# Altium schematic sheet fpga-tx.SchDoc (continued)
## Parts (continued)
C?#46  value 0.01uF  [0402]  (hidden comment: CAP 0402)
C?#47  value 0.1uF  [0402]  (hidden comment: CAP 0402)
C?#48  value 0.1uF  [0402]  (hidden comment: CAP 0402)
C?#49  value 1uF  [0402]  (hidden comment: CAP 0402)
C?#50  value 0.01uF  [0402]  (hidden comment: CAP 0402)
L?#1  value 600@100MHz  [0402]  (hidden comment: IND 0402)
L?#2  value 600@100MHz  [0402]  (hidden comment: IND 0402)
L?#3  value 600@100MHz  [0402]  (hidden comment: IND 0402)
L?#4  value 600@100MHz  [0402]  (hidden comment: IND 0402)
L?#5  value 600@100MHz  [0402]  (hidden comment: IND 0402)
L?#6  value 600@100MHz  [0402]  (hidden comment: IND 0402)
L?#7  value 600@100MHz  [0402]  (hidden comment: IND 0402)
L?#8  value 600@100MHz  [0402]  (hidden comment: IND 0402)
L?#9  value 600@100MHz  [0402]  (hidden comment: IND 0402)
L?#10  value 600@100MHz  [0402]  (hidden comment: IND 0402)
U?#1  LFE5U-85F-BG756  (part D of 11)
U?#2  LFE5U-85F-BG756  (part A of 11)
U?#3  LFE5U-85F-BG756  (part B of 11)
U?#4  LFE5U-85F-BG756  (part E of 11)
U?#5  LFE5U-85F-BG756  (part I of 11)
U?#6  LFE5U-85F-BG756  (part F of 11)
U?#7  LFE5U-85F-BG756  (part G of 11)
U?#8  LFE5U-85F-BG756  (part C of 11)
U?#9  LFE5U-85F-BG756  (part K of 11)
U?#10  LFE5U-85F-BG756  (part H of 11)
U?#11  LFE5U-85F-BG756  (part J of 11)

## Ports
CTRL0 (harness CTRL), CTRL1 (harness CTRL), DAC-LVDS (harness DAC-LVDS), EAST (harness NODE-BRIDGE), FPGA-CLK_N, FPGA-CLK_P, FPGA-CONFIG (harness FPGA-CONFIG), GPMC (harness GPMC), NORTH (harness NODE-BRIDGE), TRANSMIT

## Harnesses
DAC-LVDS: DAC-D0_P, DAC-D0_N, DAC-D1_P, DAC-D1_N, DAC-D2_P, DAC-D2_N, DAC-D3_P, DAC-D3_N, DAC-D4_P, DAC-D4_N, DAC-D5_P, DAC-D5_N, DAC-D6_P, DAC-D6_N, DAC-D7_P, DAC-D7_N, DAC-D8_P, DAC-D8_N, DAC-D9_P, DAC-D9_N, DAC-D10_P, DAC-D10_N, DAC-D11_P, DAC-D11_N, DAC-D12_P, DAC-D12_N, DAC-D13_P, DAC-D13_N, DAC-D14_P, DAC-D14_N, DAC-D15_P, DAC-D15_N, DAC-DCLK_P, DAC-DCLK_N, DAC-SYNC_P, DAC-SYNC_N, DAC-PARITY_P, DAC-PARITY_N, DAC-OSTR_P, DAC-OSTR_N, DAC-FRAME_P, DAC-FRAME_N
CTRL: S0, S1, S2, S3, S4, S5
NODE-BRIDGE: DCLK, D0, D1, D2, D3, D4, D5, D6, D7, D8, D9, D10, D11, D12, D13, D14, D15, D16, D17, D18, D19, D20, D21, D22, D23, D24, D25, D26, D27, D28, D29, D30, D31, D32, D33, D34, D35, D36, D37, D38, D39, D40, D41, D42, D43, D44, D45, D46, D47, D48, D49, D50, D51, D52, D53, D54, D55, D56, D57, D58, D59, D60, D61, D62, D63
FPGA-CONFIG: SSN, SCK, MISO, MOSI, DOUT, DIN, DONE, INITN, TDI, TDO, TCK, TMS, PROG_N
GPMC: S0, S1, S2, S3, S4, S5, S6, S7, S8, S9, S10, S11, S12, S13, S14, S15, S16, S17, S18, S19, S20, S21, S22

## Nets
GND: C?#1.1 C?#2.1 C?#3.1 C?#4.1 C?#5.1 C?#6.1 C?#7.1 C?#8.1 C?#9.1 C?#10.1 C?#11.1 C?#12.1 C?#13.1 C?#14.1 C?#15.1 C?#16.1 C?#17.1 C?#18.1 C?#19.1 C?#20.1 C?#21.1 C?#22.1 C?#23.1 C?#24.1 C?#25.1 C?#26.1 C?#27.1 C?#28.1 C?#29.1 C?#30.1 C?#31.1 C?#32.1 C?#33.1 C?#34.1 C?#35.1 C?#36.1 C?#37.1 C?#38.1 C?#39.1 C?#40.1 C?#41.1 C?#42.1 C?#43.1 C?#44.1 C?#45.1 C?#46.1 C?#47.1 C?#48.1 C?#49.1 C?#50.1 U?#5.AA11(GND) U?#5.AA22(GND) U?#5.AB11(GND) U?#5.AB12(GND) U?#5.AB13(GND) U?#5.AB14(GND) U?#5.AB15(GND) U?#5.AB16(GND) U?#5.AB17(GND) U?#5.AB18(GND) U?#5.AB19(GND) U?#5.AB20(GND) U?#5.AB21(GND) U?#5.AB22(GND) U?#5.AC12(GND) U?#5.AC21(GND) U?#5.AD2(GND) U?#5.AD5(GND) U?#5.AD28(GND) U?#5.AD31(GND) U?#5.AF11(GND) U?#5.AF12(GND) U?#5.AF14(GND) U?#5.AF15(GND) U?#5.AF16(GND) U?#5.AF17(GND) U?#5.AF19(GND) U?#5.AF20(GND) U?#5.AF23(GND) U?#5.AG11(GND) U?#5.AG14(GND) U?#5.AG15(GND) U?#5.AG16(GND) U?#5.AG17(GND) U?#5.AG20(GND) U?#5.AG23(GND) U?#5.AH2(GND) U?#5.AH5(GND) U?#5.AH7(GND) U?#5.AH8(GND) U?#5.AH11(GND) U?#5.AH14(GND) U?#5.AH15(GND) U?#5.AH16(GND) U?#5.AH17(GND) U?#5.AH20(GND) U?#5.AH23(GND) U?#5.AH24(GND) U?#5.AH25(GND) U?#5.AH26(GND) U?#5.AH29(GND) U?#5.AH31(GND) U?#5.AJ7(GND) U?#5.AJ8(GND) U?#5.AJ11(GND) U?#5.AJ14(GND) U?#5.AJ17(GND) U?#5.AJ20(GND) U?#5.AJ23(GND) U?#5.AJ26(GND) U?#5.AK7(GND) U?#5.AK8(GND) U?#5.AK11(GND) U?#5.AK14(GND) U?#5.AK17(GND) U?#5.AK20(GND) U?#5.AK23(GND) U?#5.AK26(GND) U?#5.AL2(GND) U?#5.AL5(GND) U?#5.AL7(GND) U?#5.AL8(GND) U?#5.AL9(GND) U?#5.AL11(GND) U?#5.AL12(GND) U?#5.AL14(GND) U?#5.AL15(GND) U?#5.AL17(GND) U?#5.AL18(GND) U?#5.AL20(GND) U?#5.AL21(GND) U?#5.AL23(GND) U?#5.AL24(GND) U?#5.AL26(GND) U?#5.AL29(GND) U?#5.AL31(GND) U?#5.AM7(GND) U?#5.AM14(GND) U?#5.AM15(GND) U?#5.AM26(GND) U?#5.B2(GND) U?#5.B5(GND) U?#5.B9(GND) U?#5.B13(GND) U?#5.B15(GND) U?#5.B18(GND) U?#5.B20(GND) U?#5.B24(GND) U?#5.B28(GND) U?#5.B31(GND) U?#5.E2(GND) U?#5.E5(GND) U?#5.E9(GND) U?#5.E13(GND) U?#5.E15(GND) U?#5.E18(GND) U?#5.E20(GND) U?#5.E24(GND) U?#5.E28(GND) U?#5.E31(GND) U?#5.J2(GND) U?#5.J5(GND) U?#5.J28(GND) U?#5.J31(GND) U?#5.K10(GND) U?#5.K11(GND) U?#5.K22(GND) U?#5.K23(GND) U?#5.L10(GND) U?#5.L11(GND) U?#5.L12(GND) U?#5.L13(GND) U?#5.L14(GND) U?#5.L15(GND) U?#5.L16(GND) U?#5.L17(GND) U?#5.L18(GND) U?#5.L19(GND) U?#5.L20(GND) U?#5.L21(GND) U?#5.L22(GND) U?#5.L23(GND) U?#5.M11(GND) U?#5.M22(GND) U?#5.N2(GND) U?#5.N5(GND) U?#5.N11(GND) U?#5.N13(GND) U?#5.N14(GND) U?#5.N15(GND) U?#5.N16(GND) U?#5.N17(GND) U?#5.N18(GND) U?#5.N19(GND) U?#5.N20(GND) U?#5.N22(GND) U?#5.N28(GND) U?#5.N31(GND) U?#5.P11(GND) U?#5.P13(GND) U?#5.P14(GND) U?#5.P15(GND) U?#5.P16(GND) U?#5.P17(GND) U?#5.P18(GND) U?#5.P19(GND) U?#5.P20(GND) U?#5.P22(GND) U?#5.R2(GND) U?#5.R5(GND) U?#5.R11(GND) U?#5.R13(GND) U?#5.R14(GND) U?#5.R15(GND) U?#5.R16(GND) U?#5.R17(GND) U?#5.R18(GND) U?#5.R19(GND) U?#5.R20(GND) U?#5.R22(GND) U?#5.R28(GND) U?#5.R31(GND) U?#5.T11(GND) U?#5.T13(GND) U?#5.T14(GND) U?#5.T15(GND) U?#5.T16(GND) U?#5.T17(GND) U?#5.T18(GND) U?#5.T19(GND) U?#5.T20(GND) U?#5.T22(GND) U?#5.U11(GND) U?#5.U13(GND) U?#5.U14(GND) U?#5.U15(GND) U?#5.U16(GND) U?#5.U17(GND) U?#5.U18(GND) U?#5.U19(GND) U?#5.U20(GND) U?#5.U22(GND) U?#5.V2(GND) U?#5.V5(GND) U?#5.V11(GND) U?#5.V13(GND) U?#5.V14(GND) U?#5.V15(GND) U?#5.V16(GND) U?#5.V17(GND) U?#5.V18(GND) U?#5.V19(GND) U?#5.V20(GND) U?#5.V22(GND) U?#5.V28(GND) U?#5.V31(GND) U?#5.W11(GND) U?#5.W13(GND) U?#5.W14(GND) U?#5.W15(GND) U?#5.W16(GND) U?#5.W17(GND) U?#5.W18(GND) U?#5.W19(GND) U?#5.W20(GND) U?#5.W22(GND) U?#5.Y2(GND) U?#5.Y11(GND) U?#5.Y13(GND) U?#5.Y14(GND) U?#5.Y15(GND) U?#5.Y16(GND) U?#5.Y17(GND) U?#5.Y18(GND) U?#5.Y19(GND) U?#5.Y20(GND) U?#5.Y22(GND) U?#5.Y31(GND) U?#9.AC13(GND) U?#9.AC14(GND) U?#9.AC15(GND) U?#9.AC16(GND) U?#9.AC17(GND) U?#9.AC18(GND) U?#9.AC19(GND) U?#9.AC20(GND) U?#9.AM8(GND) U?#9.AM9(GND) U?#9.AM11(GND) U?#9.AM12(GND) U?#9.AM17(GND) U?#9.AM18(GND) U?#9.AM20(GND) U?#9.AM21(GND) U?#9.AM23(GND) U?#9.AM24(GND) U?#11.AF22(GND) U?#11.AG9(GND) U?#11.AG12(GND) U?#11.AG19(GND) U?#11.AG22(GND) U?#11.AH9(GND) U?#11.AH12(GND) U?#11.AH19(GND) U?#11.AH22(GND) U?#11.AJ9(GND) U?#11.AJ10(GND) U?#11.AJ12(GND) U?#11.AJ13(GND) U?#11.AJ15(GND) U?#11.AJ16(GND) U?#11.AJ18(GND) U?#11.AJ19(GND) U?#11.AJ21(GND) U?#11.AJ22(GND) U?#11.AJ24(GND) U?#11.AJ25(GND)
PP3V3: C?#3.2 C?#6.2 C?#12.2 C?#18.2 C?#24.2 C?#30.2 C?#34.2 C?#40.2 C?#46.2 C?#50.2 L?#1.1 L?#2.1 L?#3.1 L?#4.1 L?#5.1 L?#6.1 L?#7.1 L?#8.1 L?#9.1 L?#10.1
CTRL0.S0: U?#4.AH28(PB112B)
CTRL0.S1: U?#4.AH30(PB114A)
CTRL0.S2: U?#4.AG30(PB114B)
CTRL0.S3: U?#4.AK29(PB116A)
CTRL0.S4: U?#4.AK30(PB116B)
CTRL0.S5: U?#4.AH32(PB119A)
CTRL1.S0: U?#4.AJ29(PB121A)
CTRL1.S1: U?#4.AJ30(PB121B)
CTRL1.S2: U?#4.AM28(PB96A)
CTRL1.S3: U?#4.AM29(PB96B)
CTRL1.S4: U?#4.AL28(PB98A)
CTRL1.S5: U?#4.AK28(PB98B)
DAC-D0_N: U?#7.D5(PL11B/_ULC_GPLL0C_IN) ; port DAC-LVDS.DAC-D0_N
DAC-D0_P: U?#7.C5(PL11A/_ULC_GPLL0T_IN) ; port DAC-LVDS.DAC-D0_P
DAC-D1_N: U?#7.C3(PL11D/_ULC_GPLL0C_MFGOUT2) ; port DAC-LVDS.DAC-D1_N
DAC-D1_P: U?#7.C4(PL11C/_ULC_GPLL0T_MFGOUT2) ; port DAC-LVDS.DAC-D1_P
DAC-D2_N: U?#7.E4(PL14B/_ULC_GPLL0C_MFGOUT1) ; port DAC-LVDS.DAC-D2_N
DAC-D2_P: U?#7.D4(PL14A/_ULC_GPLL0T_MFGOUT1) ; port DAC-LVDS.DAC-D2_P
DAC-D3_N: U?#7.F5(PL14D) ; port DAC-LVDS.DAC-D3_N
DAC-D3_P: U?#7.F4(PL14C) ; port DAC-LVDS.DAC-D3_P
DAC-D4_N: U?#7.D2(PL17D) ; port DAC-LVDS.DAC-D4_N
DAC-D4_P: U?#7.D3(PL17C) ; port DAC-LVDS.DAC-D4_P
DAC-D5_N: U?#7.E3(PL20B) ; port DAC-LVDS.DAC-D5_N
DAC-D5_P: U?#7.F3(PL20A) ; port DAC-LVDS.DAC-D5_P
DAC-D6_N: U?#7.D1(PL20D) ; port DAC-LVDS.DAC-D6_N
DAC-D6_P: U?#7.C1(PL20C) ; port DAC-LVDS.DAC-D6_P
DAC-D7_N: U?#7.E1(PL23B) ; port DAC-LVDS.DAC-D7_N
DAC-D7_P: U?#7.F2(PL23A) ; port DAC-LVDS.DAC-D7_P
DAC-D8_N: U?#7.H1(PL23D) ; port DAC-LVDS.DAC-D8_N
DAC-D8_P: U?#7.F1(PL23C) ; port DAC-LVDS.DAC-D8_P
DAC-D9_N: U?#7.H3(PL26B) ; port DAC-LVDS.DAC-D9_N
DAC-D9_P: U?#7.H2(PL26A) ; port DAC-LVDS.DAC-D9_P
DAC-D10_N: U?#7.K3(PL26D) ; port DAC-LVDS.DAC-D10_N
DAC-D10_P: U?#7.J3(PL26C) ; port DAC-LVDS.DAC-D10_P
DAC-D11_N: U?#7.L1(PL29D) ; port DAC-LVDS.DAC-D11_N
DAC-D11_P: U?#7.K1(PL29C) ; port DAC-LVDS.DAC-D11_P
DAC-D12_N: U?#7.L3(PL32B) ; port DAC-LVDS.DAC-D12_N
DAC-D12_P: U?#7.L2(PL32A) ; port DAC-LVDS.DAC-D12_P
DAC-D13_N: U?#7.K4(PL32D) ; port DAC-LVDS.DAC-D13_N
DAC-D13_P: U?#7.J4(PL32C) ; port DAC-LVDS.DAC-D13_P
DAC-D14_N: U?#7.J6(PL35D) ; port DAC-LVDS.DAC-D14_N
DAC-D14_P: U?#7.J7(PL35C/_VREF1_7) ; port DAC-LVDS.DAC-D14_P
DAC-D15_N: U?#7.K7(PL38B) ; port DAC-LVDS.DAC-D15_N
DAC-D15_P: U?#7.K6(PL38A) ; port DAC-LVDS.DAC-D15_P
DAC-DCLK_N: U?#7.C2(PL17B) ; port DAC-LVDS.DAC-DCLK_N
DAC-DCLK_P: U?#7.B1(PL17A) ; port DAC-LVDS.DAC-DCLK_P
DAC-FRAME_N: U?#7.N7(PL44B/_PCLKC7_1) ; port DAC-LVDS.DAC-FRAME_N
DAC-FRAME_P: U?#7.N6(PL44A/_PCLKT7_1) ; port DAC-LVDS.DAC-FRAME_P
DAC-OSTR_N: U?#7.L6(PL41D) ; port DAC-LVDS.DAC-OSTR_N
DAC-OSTR_P: U?#7.L7(PL41C/_GR_PCLK7_0) ; port DAC-LVDS.DAC-OSTR_P
DAC-PARITY_N: U?#7.N4(PL41B) ; port DAC-LVDS.DAC-PARITY_N
DAC-PARITY_P: U?#7.N3(PL41A/_GR_PCLK7_1) ; port DAC-LVDS.DAC-PARITY_P
DAC-REFCLK_N: U?#1.AE32(PR92D/_LRC_GPLL0C_IN/S7_OUT) ; port FPGA-CLK_N
DAC-REFCLK_P: U?#1.AD32(PR92C/_LRC_GPLL0T_IN) ; port FPGA-CLK_P
DAC-SYNC_N: U?#7.L4(PL38D) ; port DAC-LVDS.DAC-SYNC_N
DAC-SYNC_P: U?#7.K5(PL38C) ; port DAC-LVDS.DAC-SYNC_P
EAST.D0: U?#1.P28(PR47A/_PCLKT3_1/S3_OUT)
EAST.D1: U?#1.P29(PR47B/_PCLKC3_1)
EAST.D2: U?#1.R26(PR47C/_PCLKT3_0/S4_IN)
EAST.D3: U?#1.T26(PR47D/_PCLKC3_0)
EAST.D4: U?#1.R27(PR50A/_GR_PCLK3_0)
EAST.D5: U?#1.T27(PR50B)
EAST.D6: U?#1.U27(PR50C/_GR_PCLK3_1)
EAST.D7: U?#1.U26(PR50D)
EAST.D8: U?#1.R29(PR53A)
EAST.D9: U?#1.T28(PR53B)
EAST.D10: U?#1.T29(PR53C)
EAST.D11: U?#1.U28(PR53D)
EAST.D12: U?#1.U29(PR56A/_S4_OUT)
EAST.D13: U?#1.V29(PR56B/_VREF1_3)
EAST.D14: U?#1.V27(PR56C/_S5_IN)
EAST.D15: U?#1.V26(PR56D)
EAST.D16: U?#1.P31(PR59A)
EAST.D17: U?#1.P30(PR59B)
EAST.D18: U?#1.R30(PR59C)
EAST.D19: U?#1.T30(PR59D)
EAST.D20: U?#1.N32(PR62A)
EAST.D21: U?#1.P32(PR62B)
EAST.D22: U?#1.U31(PR62C)
EAST.D23: U?#1.U30(PR62D)
EAST.D24: U?#1.R32(PR65A)
EAST.D25: U?#1.T31(PR65B)
EAST.D26: U?#1.W30(PR65C)
EAST.D27: U?#1.Y30(PR65D)
EAST.D28: U?#1.T32(PR68A)
EAST.D29: U?#1.U32(PR68B)
EAST.D30: U?#1.V32(PR68C)
EAST.D31: U?#1.W32(PR68D)
EAST.D32: U?#1.Y26(PR71A)
EAST.D33: U?#1.Y27(PR71B)
EAST.D34: U?#1.Y28(PR71C)
EAST.D35: U?#1.W28(PR71D)
EAST.D36: U?#1.Y29(PR74A)
EAST.D37: U?#1.W29(PR74B)
EAST.D38: U?#1.AB26(PR74C)
EAST.D39: U?#1.AC27(PR74D)
EAST.D40: U?#1.AB28(PR77A)
EAST.D41: U?#1.AB27(PR77B)
EAST.D42: U?#1.AC26(PR77C)
EAST.D43: U?#1.AD26(PR77D)
EAST.D44: U?#1.AD27(PR80A)
EAST.D45: U?#1.AE27(PR80B)
EAST.D46: U?#1.AE28(PR80C)
EAST.D47: U?#1.AE29(PR80D)
EAST.D48: U?#1.AB29(PR83B/_S6_IN)
EAST.D49: U?#1.AC28(PR83C)
EAST.D50: U?#1.AD29(PR83D)
EAST.D51: U?#1.W31(PR86A/_S6_OUT)
EAST.D52: U?#1.Y32(PR86B/_S7_IN)
EAST.D53: U?#1.AD30(PR86C)
EAST.D54: U?#1.AE30(PR86D)
EAST.D55: U?#1.AC30(PR89A)
EAST.D56: U?#1.AB31(PR89B)
EAST.D57: U?#1.AC31(PR89C/_LRC_GPLL0T_MFGOUT2)
EAST.D58: U?#1.AE31(PR89D/_LRC_GPLL0C_MFGOUT2)
EAST.D59: U?#1.AB32(PR92A/_LRC_GPLL0T_MFGOUT1)
EAST.D60: U?#1.AC32(PR92B/_LRC_GPLL0C_MFGOUT1)
EAST.D61: U?#4.AK32(PB101A)
EAST.D62: U?#4.AJ32(PB101B)
EAST.D63: U?#4.AM30(PB103A)
EAST.DCLK: U?#1.AB30(PR83A/_S5_OUT)
FPGA-CONFIG.DIN: U?#10.AJ3(PB15A/_HOLDN/DI/BUSY/CSSPIN/CEN) ; port FPGA-CONFIG.DIN
FPGA-CONFIG.DONE: U?#10.AJ4(DONE) ; port FPGA-CONFIG.DONE
FPGA-CONFIG.DOUT: U?#10.AK3(PB15B/_DOUT/CSON/ATB_FORCE) ; port FPGA-CONFIG.DOUT
FPGA-CONFIG.INITN: U?#10.AG4(INITN) ; port FPGA-CONFIG.INITN
FPGA-CONFIG.MISO: U?#10.AJ2(PB11A/_D1/MISO/IO1) ; port FPGA-CONFIG.MISO
FPGA-CONFIG.MOSI: U?#10.AK2(PB11B/_D0/MOSI/IO0) ; port FPGA-CONFIG.MOSI
FPGA-CONFIG.PROG_N: U?#10.AH4(PROGRAMN) ; port FPGA-CONFIG.PROG_N
FPGA-CONFIG.SCK: U?#10.AM3(CCLK/_MCLK/SCK) ; port FPGA-CONFIG.SCK
FPGA-CONFIG.SSN: U?#10.AG3(PB13A/_SN/CSN/SCAN_SHFT_EN) ; port FPGA-CONFIG.SSN
FPGA-CONFIG.TCK: U?#10.AK5(TCK/_TEST_CLK) ; port FPGA-CONFIG.TCK
FPGA-CONFIG.TDI: U?#10.AJ5(TDI) ; port FPGA-CONFIG.TDI
FPGA-CONFIG.TDO: U?#10.AG5(TDO) ; port FPGA-CONFIG.TDO
FPGA-CONFIG.TMS: U?#10.AM5(TMS) ; port FPGA-CONFIG.TMS
GPMC.S0: U?#3.F18(PT74B/_GR_PCLK1_1) ; port GPMC.S0
GPMC.S1: U?#3.A19(PT76A) ; port GPMC.S1
GPMC.S2: U?#3.B19(PT76B) ; port GPMC.S2
GPMC.S3: U?#3.C19(PT78A) ; port GPMC.S3
GPMC.S4: U?#3.D19(PT78B) ; port GPMC.S4
GPMC.S5: U?#3.E19(PT80A) ; port GPMC.S5
GPMC.S6: U?#3.F19(PT80B) ; port GPMC.S6
GPMC.S7: U?#3.A20(PT83A) ; port GPMC.S7
GPMC.S8: U?#3.C20(PT83B) ; port GPMC.S8
GPMC.S9: U?#3.D20(PT85A) ; port GPMC.S9
GPMC.S10: U?#3.F20(PT85B) ; port GPMC.S10
GPMC.S11: U?#3.A22(PT87A) ; port GPMC.S11
GPMC.S12: U?#3.B22(PT87B) ; port GPMC.S12
GPMC.S13: U?#3.C22(PT89A) ; port GPMC.S13
GPMC.S14: U?#3.D22(PT89B) ; port GPMC.S14
GPMC.S15: U?#3.E22(PT92A) ; port GPMC.S15
GPMC.S16: U?#3.F22(PT92B) ; port GPMC.S16
GPMC.S17: U?#3.A23(PT94A) ; port GPMC.S17
GPMC.S18: U?#3.B23(PT94B) ; port GPMC.S18
GPMC.S19: U?#3.C23(PT96A) ; port GPMC.S19
GPMC.S20: U?#3.D23(PT96B) ; port GPMC.S20
GPMC.S21: U?#3.E23(PT98A) ; port GPMC.S21
GPMC.S22: U?#3.F23(PT98B) ; port GPMC.S22
NORTH.D0: U?#8.C28(PR11A/_URC_GPLL0T_IN)
NORTH.D1: U?#8.D28(PR11B/_URC_GPLL0C_IN/S0_IN)
NORTH.D2: U?#8.C29(PR11C/_URC_GPLL0T_MFGOUT2)
NORTH.D3: U?#8.C30(PR11D/_URC_GPLL0C_MFGOUT2)
NORTH.D4: U?#8.D29(PR14A/_S0_OUT)
NORTH.D5: U?#8.E29(PR14B/_S1_IN)
NORTH.D6: U?#8.F29(PR14C)
NORTH.D7: U?#8.F28(PR14D)
NORTH.D8: U?#8.B32(PR17A/_URC_GPLL0T_MFGOUT1)
NORTH.D9: U?#8.C31(PR17B/_URC_GPLL0C_MFGOUT1)
NORTH.D10: U?#8.D30(PR17C)
NORTH.D11: U?#8.D31(PR17D)
NORTH.D12: U?#8.F30(PR20A)
NORTH.D13: U?#8.E30(PR20B)
NORTH.D14: U?#8.C32(PR20C)
NORTH.D15: U?#8.D32(PR20D)
NORTH.D16: U?#8.F31(PR23A)
NORTH.D17: U?#8.E32(PR23B)
NORTH.D18: U?#8.F32(PR23C)
NORTH.D19: U?#8.H32(PR23D)
NORTH.D20: U?#8.H31(PR26A)
NORTH.D21: U?#8.H30(PR26B)
NORTH.D22: U?#8.J30(PR26C)
NORTH.D23: U?#8.K30(PR26D)
NORTH.D24: U?#8.K31(PR29A)
NORTH.D25: U?#8.J32(PR29B)
NORTH.D26: U?#8.K32(PR29C)
NORTH.D27: U?#8.L32(PR29D)
NORTH.D28: U?#8.L31(PR32A)
NORTH.D29: U?#8.L30(PR32B)
NORTH.D30: U?#8.J29(PR32C)
NORTH.D31: U?#8.K29(PR32D)
NORTH.D32: U?#8.H27(PR35A/_S1_OUT)
NORTH.D33: U?#8.H28(PR35B/_S2_IN)
NORTH.D34: U?#8.J26(PR35C/_VREF1_2)
NORTH.D35: U?#8.J27(PR35D)
NORTH.D36: U?#8.K27(PR38A)
NORTH.D37: U?#8.K26(PR38B)
NORTH.D38: U?#8.K28(PR38C)
NORTH.D39: U?#8.L29(PR38D)
NORTH.D40: U?#8.N29(PR41B)
NORTH.D41: U?#8.L26(PR41C/_GR_PCLK2_0)
NORTH.D42: U?#8.L27(PR41D)
NORTH.D43: U?#8.N27(PR44A/_PCLKT2_1/S2_OUT)
NORTH.D44: U?#8.N26(PR44B/_PCLKC2_1)
NORTH.D45: U?#8.P27(PR44C/_PCLKT2_0/S3_IN)
NORTH.D46: U?#8.P26(PR44D/_PCLKC2_0)
NORTH.D47: U?#3.A24(PT101A)
NORTH.D48: U?#3.C24(PT101B)
NORTH.D49: U?#3.D24(PT103A)
NORTH.D50: U?#3.F24(PT103B)
NORTH.D51: U?#3.A25(PT105A)
NORTH.D52: U?#3.B25(PT105B)
NORTH.D53: U?#3.C25(PT107A)
NORTH.D54: U?#3.D25(PT107B)
NORTH.D55: U?#3.E25(PT110A)
NORTH.D56: U?#3.F25(PT110B)
NORTH.D57: U?#3.A26(PT112A)
NORTH.D58: U?#3.B26(PT112B)
NORTH.D59: U?#3.C26(PT114A)
NORTH.D60: U?#3.D26(PT114B)
NORTH.D61: U?#3.A28(PT116A)
NORTH.D62: U?#3.A29(PT116B)
NORTH.D63: U?#3.A30(PT119A)
NORTH.DCLK: U?#8.N30(PR41A/_GR_PCLK2_1)
TRANSMIT: U?#7.P7(PL44D/_PCLKC7_0) ; port TRANSMIT
VCC-CORE: C?#1.2 C?#2.2 L?#1.2 U?#11.AA12(VCC) U?#11.AA13(VCC) U?#11.AA14(VCC) U?#11.AA15(VCC) U?#11.AA16(VCC) U?#11.AA17(VCC) U?#11.AA18(VCC) U?#11.AA19(VCC) U?#11.AA20(VCC) U?#11.AA21(VCC) U?#11.M12(VCC) U?#11.M13(VCC) U?#11.M14(VCC) U?#11.M15(VCC) U?#11.M16(VCC) U?#11.M17(VCC) U?#11.M18(VCC) U?#11.M19(VCC) U?#11.M20(VCC) U?#11.M21(VCC) U?#11.N12(VCC) U?#11.N21(VCC) U?#11.P12(VCC) U?#11.P21(VCC) U?#11.R12(VCC) U?#11.R21(VCC) U?#11.T12(VCC) U?#11.T21(VCC) U?#11.U12(VCC) U?#11.U21(VCC) U?#11.V12(VCC) U?#11.V21(VCC) U?#11.W12(VCC) U?#11.W21(VCC) U?#11.Y12(VCC) U?#11.Y21(VCC)
VCCAUX: C?#4.2 C?#5.2 L?#2.2 U?#11.AC11(VCCAUX) U?#11.AC22(VCCAUX) U?#11.K13(VCCAUX) U?#11.K20(VCCAUX) U?#11.N10(VCCAUX) U?#11.N23(VCCAUX) U?#11.Y10(VCCAUX) U?#11.Y23(VCCAUX)
VCCIO0: C?#7.2 C?#8.2 C?#9.2 C?#10.2 C?#11.2 L?#3.2 U?#2.K12(VCCIO0) U?#2.K14(VCCIO0) U?#2.K15(VCCIO0) U?#2.K16(VCCIO0)
VCCIO1: C?#13.2 C?#14.2 C?#15.2 C?#16.2 C?#17.2 L?#4.2 U?#3.K17(VCCIO1) U?#3.K18(VCCIO1) U?#3.K19(VCCIO1) U?#3.K21(VCCIO1)
VCCIO2: C?#19.2 C?#20.2 C?#21.2 C?#22.2 C?#23.2 L?#5.2 U?#8.M23(VCCIO2) U?#8.P23(VCCIO2) U?#8.R23(VCCIO2) U?#8.T23(VCCIO2)
VCCIO3: C?#25.2 C?#26.2 C?#27.2 C?#28.2 C?#29.2 L?#6.2 U?#1.AA23(VCCIO3) U?#1.U23(VCCIO3) U?#1.V23(VCCIO3) U?#1.W23(VCCIO3)
VCCIO4: C?#31.2 C?#32.2 C?#33.2 L?#7.2 U?#4.AB23(VCCIO4) U?#4.AC23(VCCIO4)
VCCIO6: C?#35.2 C?#36.2 C?#37.2 C?#38.2 C?#39.2 L?#8.2 U?#6.AA10(VCCIO6) U?#6.U10(VCCIO6) U?#6.V10(VCCIO6) U?#6.W10(VCCIO6)
VCCIO7: C?#41.2 C?#42.2 C?#43.2 C?#44.2 C?#45.2 L?#9.2 U?#7.M10(VCCIO7) U?#7.P10(VCCIO7) U?#7.R10(VCCIO7) U?#7.T10(VCCIO7)
VCCIO8: C?#47.2 C?#48.2 C?#49.2 L?#10.2 U?#10.AB10(VCCIO8) U?#10.AC10(VCCIO8)

Not connected (* = marked no-connect by the designer): U?#2 A2(PT6A) A3(PT6B) A4(PT9A) A5(PT9B) A7(PT13B) A8(PT20B) A9(PT24B) A10(PT31B) A11(PT38B) A13(PT42B) A14(PT49B) A15(PT54B) A16(PT60B/_GR_PCLK0_0) A17(PT63A/_PCLKT0_1) B3(PT4A/_ULC_GPLL1T_IN) B4(PT4B/_ULC_GPLL1C_IN) B7(PT13A) B8(PT20A) B10(PT31A) B11(PT38A) B14(PT49A) B16(PT60A/_GR_PCLK0_1) B17(PT63B/_PCLKC0_1) C7(PT11B) C8(PT18B) C9(PT24A) C10(PT29B) C11(PT36B) C13(PT42A) C14(PT47B) C15(PT54A) C16(PT58B) C17(PT65A/_PCLKT0_0) D7(PT11A) D8(PT18A) D9(PT22B) D10(PT29A) D11(PT36A) D13(PT40B) D14(PT47A) D15(PT51B) D16(PT58A) D17(PT65B/_PCLKC0_0) E8(PT15B) E10(PT27B) E11(PT33B) E14(PT45B) E16(PT56B) F8(PT15A) F9(PT22A) F10(PT27A) F11(PT33A) F13(PT40A) F14(PT45A) F15(PT51A) F16(PT56A); U?#3 A18(PT71A/_PCLKT1_0) A31(PT119B) B29(PT121A/_URC_GPLL1T_IN) B30(PT121B/_URC_GPLL1C_IN) C18(PT71B/_PCLKC1_0) D18(PT74A/_GR_PCLK1_0) E17(PT69A/_PCLKT1_1) F17(PT69B/_PCLKC1_1); U?#4 AG28(PB110A) AG29(PB110B) AG32(PB119B) AJ28(PB112A) AJ31(PB105B) AK31(PB105A) AL30(PB103B) AL32(PB107B) AM31(PB107A); U?#6 AB1(PL92A/_LLC_GPLL0T_MFGOUT1) AB2(PL89B/_LLC_GPLL0C_MFGOUT2) AB3(PL83A) AB4(PL83B) AB5(PL77A) AB6(PL77B) AB7(PL74C) AC1(PL92B/_LLC_GPLL0C_MFGOUT1) AC2(PL89C/_D9/IO9) AC3(PL89A/_LLC_GPLL0T_MFGOUT2) AC5(PL83C/_D15/IO15) AC6(PL74D) AC7(PL77C) AD1(PL92C/_LLC_GPLL0T_IN) AD3(PL86C/_D11/IO11) AD4(PL83D/_D14/IO14) AD6(PL80A) AD7(PL77D) AE1(PL92D/_LLC_GPLL0C_IN) AE2(PL89D/_D8/IO8) AE3(PL86D/_D10/IO10) AE4(PL80D) AE5(PL80C) AE6(PL80B) N1(PL62A) P1(PL62B) P2(PL59A) P3(PL59B) P4(PL47B/_PCLKC6_1) P5(PL47A/_PCLKT6_1) R1(PL65A) R3(PL59C) R4(PL53A) R6(PL50A/_GR_PCLK6_0) R7(PL47C/_PCLKT6_0) T1(PL68A) T2(PL65B) T3(PL59D) T4(PL53C) T5(PL53B) T6(PL50B) T7(PL47D/_PCLKC6_0) U1(PL68B) U2(PL62C) U3(PL62D) U4(PL56A) U5(PL53D) U6(PL50C/_GR_PCLK6_1) U7(PL50D) V1(PL68C) V4(PL56B/_VREF1_6) V6(PL56C) V7(PL56D) W1(PL68D) W2(PL86A/_D13/IO13) W3(PL65C) W4(PL74B) W5(PL71D) Y1(PL86B/_D12/IO12) Y3(PL65D) Y4(PL74A) Y5(PL71C) Y6(PL71B) Y7(PL71A); U?#7 H5(PL35B) H6(PL35A) J1(PL29B) K2(PL29A) P6(PL44C/_PCLKT7_0); U?#9 AC4(NC) AC29(NC) AE7(NC) AE26(NC) AG2(NC) AG24(NC) AG31(NC) AK9(RESERVED) AK10(RESERVED) AK12(RESERVED) AK13(RESERVED) AK15(RESERVED) AK16(RESERVED) AK18(RESERVED) AK19(RESERVED) AK21(RESERVED) AK22(RESERVED) AK24(RESERVED) AK25(RESERVED) E7(NC) E26(NC) G9(NC) G10(NC) G11(NC) G14(NC) G15(NC) G16(NC) G17(NC) G18(NC) G19(NC) G22(NC) G23(NC) G24(NC) H4(NC) H29(NC) L5(NC) L28(NC) V3(NC) V30(NC) W6(NC) W27(NC); U?#10 AG1(PB4A/_D7/IO7) AH1(PB4B/_D6/IO6) AH3(PB13B/_CS1N) AJ1(PB6A/_D5/MISO2/IO5) AK1(PB6B/_D4/MOSI2/IO4) AK4(CFG_2) AL1(PB9A/_D3/IO3) AL3(PB18A/_WRITEN/ATB_SENSE) AL4(CFG_1) AM2(PB9B/_D2/IO2) AM4(CFG_0)

## Buses and harness runs
harness CTRL0 = port CTRL0
harness CTRL1 = port CTRL1
harness EAST = port EAST
harness FPGA-CONFIG = port FPGA-CONFIG
harness NORTH = port NORTH

## Layout directives
differential pair: DAC-D0_N, DAC-D0_P, DAC-D1_N, DAC-D1_P, DAC-D2_N, DAC-D2_P, DAC-D3_N, DAC-D3_P, DAC-D4_N, DAC-D4_P, DAC-D5_N, DAC-D5_P, DAC-D6_N, DAC-D6_P, DAC-D7_N, DAC-D7_P, DAC-D8_N, DAC-D8_P, DAC-D9_N, DAC-D9_P, DAC-D10_N, DAC-D10_P, DAC-D11_N, DAC-D11_P, DAC-D12_N, DAC-D12_P, DAC-D13_N, DAC-D13_P, DAC-D14_N, DAC-D14_P, DAC-D15_N, DAC-D15_P, DAC-DCLK_N, DAC-DCLK_P, DAC-FRAME_N, DAC-FRAME_P, DAC-OSTR_N, DAC-OSTR_P, DAC-PARITY_N, DAC-PARITY_P, DAC-SYNC_N, DAC-SYNC_P

## Notes on the sheet
- (near U?#4) 2.5V
- (near U?#2) 2.5V
- (near U?#1) 2.5V
- (near U?#3) 2.5V
- (near U?#8) 2.5V
- (near U?#7) 3.3V
- (near U?#6) 1.5v
- NOTE: make these 0201
- (near U?#10) 3.3V
- Title
- Engineer
- Revision
- Drawn By
- Checked By
- Date
- Sheet
- of

## Library data of the parts
C?#1 C?#4 C?#7-C?#10 C?#13-C?#16 C?#19-C?#22 C?#25-C?#28 C?#31 C?#32 C?#35-C?#38 C?#41-C?#44 C?#47 C?#48 = CAP 0402: Manufacturer: Murata; Manufacturer P/N: GRM155R61A104KA01D; Voltage: 16V; PCB Package: 0402
C?#2 C?#5 C?#11 C?#17 C?#23 C?#29 C?#33 C?#39 C?#45 C?#49 = CAP 0402: Manufacturer: TDK; Manufacturer P/N: C1005X7S1A105K050BC; Voltage: 10V; PCB Package: 0402
C?#3 C?#6 C?#12 C?#18 C?#24 C?#30 C?#34 C?#40 C?#46 C?#50 = CAP 0402: Manufacturer: Murata; Manufacturer P/N: GRM155R71E103KA01D; Voltage: 25V; PCB Package: 0402
L?#1-L?#10 = IND 0402: Inductor; Manufacturer: Murata; Manufacturer P/N: BLM15PX601SN1D; PCB Package: 0402
U?#1-U?#11 = LFE5U-85F-BG756: SWAP_INFO: (S1+S2+S3+S4+S5+S6+S7+S8+S9+S10+S11); SPLIT_INST: TRUE